# Altium schematic sheet 控制板.SchDoc (part 2 of 2)
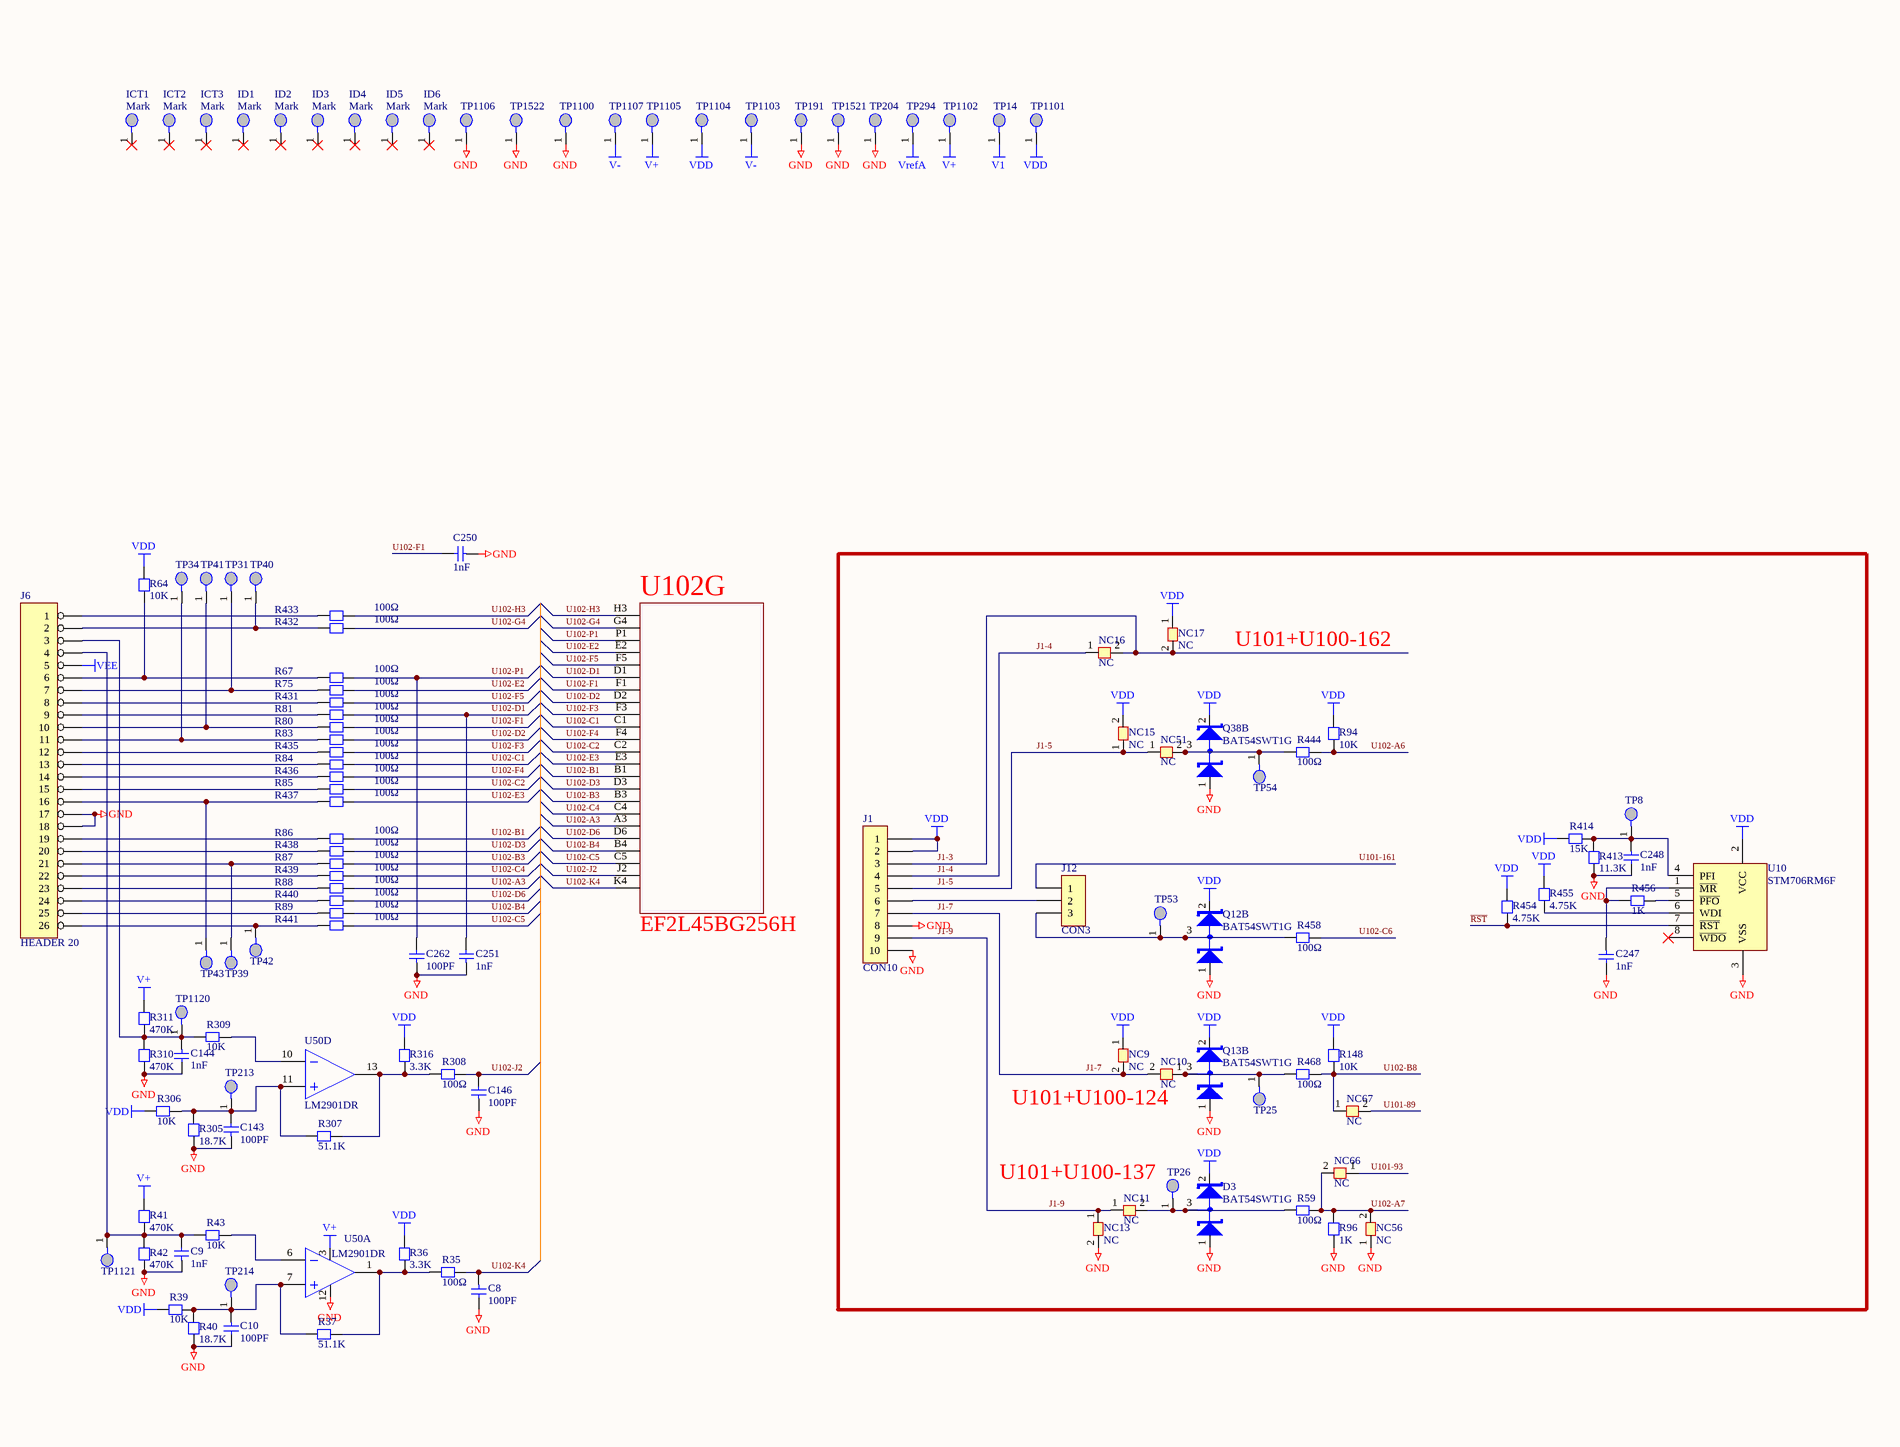
[diagram p12: 控制板.SchDoc, bottom column 4 of 4]

## Nets
GND: C4.1 C5.2 C6.1 C7.1 C8.2 C9.1 C10.2 C11.2 C12.1 C13.2 C14.1 C15.2 C16.1 C17.2 C18.2 C19.1 C20.2 C21.2 C22.2 C23.1 C24.1 C25.1 C26.2 C27.2 C28.1 C29.1 C30.1 C31.1 C32.2 C33.1 C34.1 C35.2 C36.2 C37.2 C38.2 C39.1 C40.2 C41.1 C42.1 C43.2 C44.2 C45.2 C46.1 C47.1 C48.1 C49.1 C50.2 C51.1 C52.2 C53.1 C54.1 C55.1 C56.2 C57.1 C58.1 C59.1 C60.2 C61.2 C62.2 C63.1 C64.2 C65.1 C66.2 C67.1 C68.2 C100.1 C101.1 C102.2 C103.2 C104.1 C110.2 C111.2 C116.2 C123.2 C124.1 C126.2 C127.2 C128.2 C130.1 C131.1 C132.1 C133.2 C134.1 C135.2 C136.1 C137.1 C138.1 C140.2 C141.1 C142.2 C143.1 C144.2 C145.2 C146.1 C147.1 C148.1 C149.1 C150.1 C151.1 C152.1 C153.2 C154.2 C155.1 C156.1 C157.2 C158.1 C159.1 C160.2 C161.2 C162.1 C163.1 C164.2 C165.2 C167.2 C168.1 C169.1 C170.2 C171.1 C172.1 C173.1 C174.1 C175.2 C176.1 C177.1 C178.1 C179.1 C180.2 C181.1 C182.1 C183.1 C184.1 C185.2 C186.1 C187.2 C188.1 C189.1 C190.2 C191.2 C192.2 C193.2 C194.1 C195.1 C196.1 C197.1 C198.2 C199.2 C200.2 C201.2 C202.1 C203.1 C204.1 C205.1 C206.1 C207.2 C208.1 C209.1 C210.1 C211.1 C212.1 C213.1 C214.1 C215.1 C216.1 C217.1 C218.1 C219.1 C220.1 C221.1 C222.1 C223.2 C224.2 C225.2 C226.2 C227.2 C228.2 C229.2 C230.2 C231.1 C232.1 C233.2 C234.2 C235.2 C236.2 C237.2 C238.2 C239.2 C240.2 C241.2 C242.2 C243.2 C244.1 C245.1 C246.1 C247.2 C248.2 C249.2 C250.1 C251.1 C252.2 C253.1 C254.1 C255.2 C256.1 C257.1 C258.2 C259.1 C260.1 C261.1 C262.1 C263.2 C264.1 C265.1 C266.2 C267.2 C268.1 C269.2 C270.2 C271.2 C272.1 C273.1 C274.2 C275.2 C276.1 C277.2 C278.2 C279.1 C280.1 C281.1 C282.1 C283.1 C284.1 C285.1 C286.2 C287.2 C288.2 C289.2 C290.2 C300.1 C301.1 C302.1 C303.1 C304.1 C305.1 C306.1 C307.1 C308.1 C309.1 C310.1 C311.1 C312.1 C313.1 C314.1 C315.1 C316.1 C317.1 C318.1 C319.1 C320.1 C321.1 C322.1 C323.2 C324.2 C325.2 C326.1 C327.1 C328.1 C329.2 C330.2 C331.2 C332.1 C333.1 C334.1 C335.1 C336.1 C337.1 C338.2 C339.2 C340.2 C341.1 C342.1 C343.1 C344.1 C345.1 C346.1 C347.1 C348.1 C349.1 C350.2 C351.1 C352.1 C353.1 C354.1 C355.1 C356.1 C357.1 C358.2 C359.2 C360.1 C361.1 C362.1 C363.1 C364.1 C365.1 C366.2 C367.2 C368.2 C369.1 C370.1 C371.2 C372.2 C373.2 C374.2 C375.2 C376.2 C377.2 C378.2 C379.2 C380.1 C381.2 C382.2 C383.1 C384.2 C385.2 C387.1 C388.1 C389.2 C390.2 C391.2 C392.2 C393.2 C394.2 C395.2 C396.2 C397.1 C398.1 C399.2 C400.2 C401.2 C402.2 C403.2 C404.2 C405.2 C406.2 C407.2 C408.2 C409.2 C410.1 C411.1 C413.1 C414.2 C415.1 C416.1 C417.1 C418.2 C419.1 C420.1 C421.2 C422.2 C423.1 C424.1 C425.2 C428.2 C429.1 C430.2 C431.1 C433.1 C434.2 C438.1 C439.1 C440.2 C442.1 C443.1 C444.2 C446.1 C447.2 C448.2 C449.1 C450.2 C451.2 C452.2 C453.1 C454.2 C455.2 C456.1 C457.1 C458.2 C459.2 C460.1 C461.2 C462.2 C463.1 C465.2 C466.2 C467.1 C469.1 C470.2 C473.2 C474.1 C475.1 C476.2 C477.2 C478.1 C479.2 C480.1 C481.2 C482.1 C483.1 C484.2 C485.2 C486.1 C487.2 C488.1 C492.2 C493.1 C495.1 C496.1 C497.1 C498.2 D3.1(A) D48.1 D52.1 D54.1 D55.1 D60.1 D61.1 D65.1 D68.1 D1500.1(A) D1504.1(A) D1506.1(A) D1507.1(A) D1508.1(A) D1510.1(A) D1513.1(A) D1515.1(A) D1516.1(A) D1517.1(A) D1522.1(A) D1524.1(A) D1527.1(A) D1529.1(A) D1530.1(A) D1534.1(A) D1535.1(A) D1536.1(A) D1537.1(A) D1539.1(A) D1541.1(A) D1542.1(A) D1543.1(A) D1544.1(A) D1546.1(A) J1.8 J1.10 J2.25 J2.26 J3.7 J3.25 J3.26 J4.7 J4.8 J5.6 J5.17 J6.17 J6.18 J7.1 J7.2 J7.5 J7.19 NC1.1 NC13.2 NC21.1 NC26.2 NC31.2 NC39.1 NC40.1 NC45.1 NC46.1 NC47.1 NC50.1 NC52.2 NC53.1 NC54.1 NC55.2 NC56.1 NC57.1 NC59.2 NC60.2 NC61.2 OSC1.2(GND) OSC2.2(GND) Q1B.2(E) Q2.2(E) Q2B.1(A) Q3B.1(A) Q4B.1(A) Q5B.1(A) Q6B.1(A) Q7B.1(A) Q8B.1(A) Q9.2(E) Q9B.1(A) Q10.2(E) Q10B.1(A) Q11.2(E) Q11B.1(A) Q12B.1(A) Q13.2(E) Q13B.1(A) Q14.2(E) Q14B.1(A) Q15.2(E) Q15B.1(A) Q16.2(E) Q16B.1(A) Q17B.1(A) Q18B.1(A) Q19B.1(A) Q20B.1(A) Q21B.1(A) Q22B.1(A) Q23B.1(A) Q24B.1(A) Q25B.1(A) Q26B.1(A) Q27B.2(E) Q28B.1 Q29B.1 Q30B.1 Q31B.1 Q32B.1 Q33B.1 Q34B.1 Q35B.1 Q36B.1 Q37B.1 Q38B.1(A) R19.2 R30.1 R40.1 R42.2 R52.1 R53.1 R58.2 R96.1 R108.2 R111.2 R125.1 R190.1 R193.2 R196.2 R199.2 R250.1 R251.1 R252.1 R260.1 R261.1 R262.1 R263.1 R266.2 R270.2 R279.1 R280.2 R288.2 R292.2 R294.1 R298.1 R303.1 R305.1 R310.2 R321.2 R330.1 R352.2 R367.2 R369.1 R370.1 R373.1 R375.1 R378.2 R379.2 R380.2 R381.2 R382.2 R387.2 R388.2 R390.2 R394.2 R395.2 R399.1 R400.1 R401.2 R402.2 R403.2 R404.1 R405.2 R407.2 R413.2 R416.2 R417.2 R418.2 R425.1 R426.1 R430.1 R451.1 R452.2 R471.1 R477.1 R481.1 R482.1 R483.1 R496.2 R497.2 R500.2 R504.2 R505.2 R506.2 R507.2 R508.2 R540.2 R543.2 R550.1 R565.2 R566.2 R577.2 R578.2 R579.2 R580.2 R581.2 R582.2 R592.1 R594.2 R596.2 R606.2 R607.2 R610.2 R611.2 R616.2 R618.2 R619.2 R622.2 R625.2 R636.2 R638.2 R639.1 R641.2 R664.1 R666.1 R669.2 R675.2 R676.2 R677.1 R679.2 R687.2 R690.2 R695.2 R698.2 R706.1 R709.1 R713.1 R716.1 R742.1 R744.1 R745.2 R749.1 R752.2 R755.1 R761.1 R767.2 R768.2 R771.2 R773.1 R776.2 R782.2 R783.1 R792.2 R793.2 R796.1 R797.2 R799.2 R800.1 R803.2 TP191.1 TP204.1 TP1100.1 TP1106.1 TP1521.1 TP1522.1 U1.1(Y4) U1.2(Y6) U1.4(Y7) U1.5(Y5) U1.6(E) U1.8(GND) U1.9(S2) U1.10(S1) U1.12(Y3) U1.15(Y2) U2.2(Y6) U2.4(Y7) U2.6(E) U2.8(GND) U3.8(GND) U4.6(E) U4.8(GND) U5.1(C) U7.6(E) U7.8(GND) U9.8(GND) U10.3(VSS) U11.8(GND) U12.8(GND) U16.1(GND) U17.1(GND) U18.1(GND) U19.1(GND) U20.1(GND) U21.1(GND) U24.1(E0) U24.2(E1) U24.3(E2) U24.4(VSS) U25.1(E0) U25.2(E1) U25.3(E2) U25.4(VSS) U26.2 U27.1 U29.2(K) U30.4 U36.8(GND) U50.12(V-) U100.14(VSS) U100.22(VSS) U100.37(VSSA) U100.61(VSS) U100.71(VSS) U100.90(VSS) U100.102(VSS) U100.113(VSS) U100.126(VSS) U100.135(VSS) U100.148(VSS) U100.158(VSS) U101.14(VSS) U101.22(VSS) U101.37(VSSA) U101.61(VSS) U101.71(VSS) U101.90(VSS) U101.102(VSS) U101.113(VSS) U101.126(VSS) U101.135(VSS) U101.148(VSS) U101.158(VSS) U102.B2 U102.B15 U102.C3 U102.C14 U102.D4 U102.D13 U102.E5 U102.E12 U102.F6 U102.F11 U102.H8 U102.H9 U102.J8 U102.J9 U102.L6 U102.L11 U102.M5 U102.M12 U102.N4 U102.N13 U102.P3 U102.P14 U102.R2 U102.R15 U203.12(V-) U206.12(V-) U211.12(V-) U212.12(V-) U213.12(V-)
V1: C5.1 C135.1 C153.1 C161.1 J7.6 NC37.2 NC38.2 NC42.1 NC59.1 R271.2 R281.2 R284.2 R291.2 R304.1 R604.2 R647.2 R649.1 R650.1 R657.1 R663.1 R718.1 R725.1 R726.2 R733.2 TP14.1
V2: C30.2 C108.2 C109.2 C111.1 C114.2 C115.2 C117.2 C118.2 C497.2 J7.20 Q5B.3(C) R282.2 R314.2 R315.2 R358.2 R635.1 TP15.1 TP316.1 U300.2(IN-)
V+: C31.2 C44.1 C45.1 C58.2 C59.2 C60.1 C64.1 C101.2 C110.1 C124.2 C133.1 C137.2 C152.2 C157.1 C160.1 C162.2 C167.1 C168.2 C169.2 C171.2 C176.2 C181.2 C364.2 C368.1 C377.1 C383.2 C397.2 C398.2 C409.1 C420.2 C433.2 C440.1 C453.2 C456.2 C470.1 C477.1 C484.1 J4.9 J4.10 NC1.2 NC2.1 NC12.2 NC37.1 NC38.1 NC50.2 NC53.2 NC54.2 NC70.1 NC71.2 R41.2 R268.1 R296.2 R300.2 R311.2 R597.2 R621.1 R624.1 R627.1 R637.1 TP1102.1 TP1105.1 U1.16(VCC) U2.16(VCC) U4.16(VCC) U7.16(VCC) U11.4(V+) U12.4(V+) U13.4(V+) U16.8(V+) U17.8(V+) U18.8(V+) U19.8(V+) U20.8(V+) U21.8(V+) U36.4(V+) U50.3(V+) U203.3(V+) U206.3(V+) U211.3(V+) U212.3(V+) U213.3(V+) U300.4(V+) U301.4(V+) U302.4(V+) U303.4(V+) U304.4(V+) U306.4(V+) U307.4(V+) U313.4(V+) U320.4(V+) U321.4(V+)
V-: C47.2 C48.2 C103.1 C104.2 C116.1 C127.1 C131.2 C154.1 C159.2 C163.2 C165.1 C175.1 C180.1 C185.1 C189.2 C323.1 C366.1 C380.2 C414.1 C418.1 C434.1 C444.1 C446.2 C451.1 J4.11 J4.12 NC52.1 R167.2 R541.1 R605.2 TP1103.1 TP1107.1 U13.11(V-) U16.4(V-) U17.4(V-) U18.4(V-) U19.4(V-) U20.4(V-) U21.4(V-) U300.11(V-) U301.11(V-) U302.11(V-) U303.11(V-) U304.11(V-) U306.11(V-) U307.11(V-) U313.11(V-) U320.11(V-) U321.11(V-)
VDD: C11.1 C12.2 C13.1 C15.1 C19.2 C26.1 C27.1 C33.2 C34.2 C39.2 C43.1 C50.1 C55.2 C56.1 C63.2 C170.1 C190.1 C191.1 C192.1 C193.1 C194.2 C195.2 C196.2 C202.2 C203.2 C207.1 C212.2 C224.1 C229.1 C230.1 C231.2 C232.2 C234.1 C235.1 C236.1 C237.1 C238.1 C239.1 C240.1 C241.1 C242.1 C243.1 C244.2 C245.2 C246.2 C249.1 C252.1 C253.2 C254.2 C255.1 C256.2 C257.2 C258.1 C259.2 C260.2 C263.1 C265.2 C266.1 C267.1 C268.2 C269.1 C270.1 C271.1 C272.2 C273.2 C274.1 C275.1 C276.2 C277.1 C278.1 C279.2 C280.2 C281.2 C326.2 C327.2 C328.2 C358.1 C362.2 C370.2 C496.2 D3.2(C) D48.2 D52.2 D54.2 D55.2 D60.2 D61.2 D65.2 D66.1 D67.1 D68.2 D69.1 D1500.2(C) D1504.2(C) D1506.2(C) D1507.2(C) D1508.2(C) D1510.2(C) D1513.2(C) D1515.2(C) D1516.2(C) D1517.2(C) D1522.2(C) D1524.2(C) D1527.2(C) D1529.2(C) D1530.2(C) D1534.2(C) D1535.2(C) D1536.2(C) D1537.2(C) D1539.2(C) D1541.2(C) D1542.2(C) D1543.2(C) D1544.2(C) D1546.2(C) J1.1 J1.2 J4.5 J4.6 LB1.2 LB2.1 LB4.2 LB6.1 NC3.2 NC5.1 NC6.2 NC7.2 NC8.1 NC9.1 NC15.2 NC17.1 NC21.2 NC22.2 NC23.1 NC24.1 NC25.1 NC28.2 NC32.2 NC33.1 NC34.1 NC35.2 NC36.1 NC55.1 NC57.2 NC58.1 NC62.1 NC64.1 NC68.2 NC69.2 Q2B.2(C) Q3B.2(C) Q4B.2(C) Q5B.2(C) Q6B.2(C) Q7B.2(C) Q8B.2(C) Q9B.2(C) Q10B.2(C) Q11B.2(C) Q12B.2(C) Q13B.2(C) Q14B.2(C) Q15B.2(C) Q16B.2(C) Q17B.2(C) Q18B.2(C) Q19B.2(C) Q20B.2(C) Q21B.2(C) Q22B.2(C) Q23B.2(C) Q24B.2(C) Q25B.2(C) Q26B.2(C) Q28B.2 Q29B.2 Q30B.2 Q31B.2 Q32B.2 Q33B.2 Q34B.2 Q35B.2 Q36B.2 Q37B.2 Q38B.2(C) R21.2 R36.2 R39.1 R55.2 R56.2 R60.1 R64.1 R94.1 R104.1 R112.1 R148.2 R169.2 R173.1 R174.2 R306.1 R316.1 R317.2 R328.1 R331.2 R332.1 R336.1 R340.2 R348.2 R349.2 R350.2 R351.2 R353.2 R354.2 R374.1 R376.1 R377.2 R383.2 R384.1 R385.1 R386.1 R389.2 R391.2 R392.2 R393.2 R397.1 R398.1 R406.2 R408.2 R409.2 R410.2 R411.1 R412.1 R414.1 R415.2 R419.2 R420.2 R421.2 R424.1 R427.1 R428.1 R429.1 R454.1 R455.1 R457.1 R467.2 R472.1 R473.1 R474.1 R475.1 R476.1 R478.1 R479.1 R480.1 R488.1 R490.1 R492.2 R493.1 R494.1 R495.2 R498.2 R499.2 R501.2 R502.2 R503.2 R509.2 R510.2 R511.2 R512.1 R513.1 R514.1 R515.1 R516.1 R517.1 R518.2 R522.1 R523.1 R525.1 R526.1 R527.1 R528.2 R529.1 R530.1 R531.1 R532.1 R533.1 R534.2 R535.2 R536.2 R537.2 R538.2 R539.2 R564.2 R574.2 R575.2 R583.2 R584.2 R585.2 R586.1 R587.1 R608.2 R609.2 R615.2 R617.2 R672.2 R673.2 R681.2 R682.2 R735.2 R736.2 R739.1 R740.1 R758.2 R759.2 R764.2 R765.2 R785.2 R786.2 R789.2 R790.2 TP1101.1 TP1104.1 U3.4(V+) U9.4(V+) U10.2(VCC) U24.8(VCC) U25.8(VCC) U30.8 U100.6(VBAT) U100.15(VDD) U100.23(VDD) U100.36(VDDA) U100.49(VDD) U100.62(VDD) U100.72(VDD) U100.82(VDD) U100.91(VDD) U100.103(VDD) U100.114(VDDUSB) U100.127(VDD) U100.136(VDD) U100.149(VDD) U100.159(VDD) U100.172(VDD) U101.6(VBAT) U101.15(VDD) U101.23(VDD) U101.36(VDDA) U101.49(VDD) U101.62(VDD) U101.72(VDD) U101.82(VDD) U101.91(VDD) U101.103(VDD) U101.114(VDDUSB) U101.127(VDD) U101.136(VDD) U101.149(VDD) U101.159(VDD) U101.172(VDD) U102.A1 U102.A2 U102.A16 U102.D5 U102.D12 U102.E4 U102.E13 U102.G7 U102.G8 U102.G9 U102.G10 U102.H7 U102.H10 U102.J7 U102.J10 U102.K7 U102.K8 U102.K9 U102.K10 U102.M4 U102.M13 U102.N5 U102.N12 U102.T1 U102.T16
VEE: C32.1 C49.2 C331.1 C378.1 C379.1 C403.1 C408.1 C498.1 J6.5 R167.1 R541.2 R542.2 TP16.1 U1.7(VEE) U2.7(VEE) U4.7(VEE) U5.3(A) U7.7(VEE)
VreB: R255.1 R334.2 R338.2 R342.1 TP21.1 U306.1(OUT) U306.2(IN-)
VREF: C57.2 C363.2 NC2.2 NC71.1 R257.2 R297.2 R590.2 TP44.1 U26.1 U36.7(VOUT)
VREF+: C46.2 C217.2 C218.2 C322.2 C350.1 C351.2 NC12.1 NC60.1 NC70.2 TP11.1 U11.7(VOUT) U100.38(VREF+) U101.38(VREF+)
VrefA: C386.1 C464.2 C468.2 C471.2 C472.1 C489.2 C490.1 C491.1 C494.1 J3.10 R600.2 R614.1 R747.2 R748.1 R750.1 R762.1 R769.2 R772.2 R780.2 R781.1 TP294.1 U307.13(IN-) U307.14(OUT)
VrefC: C156.2 C166.2 R324.1 R330.2 TP153.1 U16.2(IN+) U17.2(IN+) U18.2(IN+)
VrefD: C186.2 C187.1 NC36.2 NC48.2 Q6B.3(C) R359.2 R633.1 TP20.1 U9.7(VOUT) U27.3
VrefE: C14.2 C188.2 D1527.3(C) NC44.1 R21.1 R360.2 R634.1 TP19.1 U3.7(VOUT) U29.1(A)
J1-3: J1.3 NC16.2 NC17.2 U100.162(PB4) U101.162(PB4)
J1-4: J1.4 NC16.1
J1-5: J1.5 NC14.2 NC15.1 NC51.1
J1-7: J1.7 NC9.2 NC10.2 U100.124(PA13) U101.124(PA13)
J1-9: J1.9 NC11.1 NC13.1 U100.137(PA14) U101.137(PA14)
J2-1: D1507.3(C) J2.1 R556.2
J2-2: J2.2 Q23B.3(C) R571.2
J2-3: J2.3 Q24B.3(C) R557.2
J2-4: J2.4 Q15B.3(C) R545.1
J2-5: J2.5 Q20B.3(C) R568.2
J2-6: D1506.3(C) J2.6 R168.1
J2-7: J2.7 R640.2 TP501.1
J2-8: J2.8 R642.1 TP500.1
J2-9: J2.9 R697.2 TP516.1
J2-10: J2.10 R701.2 TP502.1
J2-11: J2.11 R696.2 TP209.1
J2-12: J2.12 R694.2 TP515.1
J2-13: J2.13 R688.2 TP507.1
J2-14: J2.14 R686.1 TP503.1
J2-15: J2.15 R689.2 TP508.1
J2-16: J2.16 R691.1 TP514.1
J2-17: J2.17 R715.1 TP506.1
J2-18: J2.18 R717.1 TP510.1
J2-19: J2.19 R714.1 TP504.1
J2-20: J2.20 R705.2 TP1509.1
J2-21: J2.21 R707.1 TP517.1
J2-22: J2.22 R702.1 TP511.1
J2-23: J2.23 R708.1 TP513.1
J2-24: J2.24 R710.2 TP512.1
J3-1: J3.1 R164.2 TP2.1
J3-2: D1516.3(C) J3.2 R561.2
J3-3: J3.3 R165.2
J3-4: D1517.3(C) J3.4 R572.2
J3-5: J3.5 R166.2
J3-6: J3.6 Q19B.3(C) R567.2 TP1.1
J3-8: J3.8 R179.2 TP55.1
J3-9: J3.9 R143.1
J3-11: J3.11 R156.1
J3-12: J3.12 R146.1 TP29.1
J3-13: J3.13 R137.1
J3-14: J3.14 R157.1
J3-15: J3.15 R147.1 TP30.1
J3-16: J3.16 R138.1
J3-17: J3.17 R144.1
J3-18: J3.18 R145.1
J3-19: D1530.3(C) J3.19 Q21B.3(C) R48.1 R569.2
J3-20: D1529.3(C) J3.20 Q26B.3(C) R49.1 R562.2 TP28.1
J3-21: J3.21 R602.1 TP3.1
J3-22: J3.22 Q25B.3(C) R559.2
J3-23: D1522.3(C) J3.23 R560.2 TP27.1
J3-24: J3.24 Q22B.3(C) R570.2
J7-3: D1539.3(C) J7.3 R325.1 R362.2 TP1516.1
J7-4: J7.4 Q8B.3(C) R45.1 R312.1 TP1517.1
J7-7: D1537.3(C) J7.7 R363.2
J7-8: D1536.3(C) J7.8 R46.1 TP46.1
J7-9: J7.9 Q3B.3(C) R356.2
J7-10: D1546.3(C) J7.10 R26.2
J7-11: D1541.3(C) J7.11 R29.1 TP24.1
J7-12: J7.12 Q2B.3(C) R357.2
J7-13: J7.13 R18.2 R269.1 TP1506.1
J7-14: J7.14 R15.1 R275.1 TP1505.1
J7-15: J7.15 R7.1 R293.2 TP1504.1
J7-16: J7.16 R8.2 R276.2 TP1503.1
J7-17: J7.17 R2.2 R278.2 TP1518.1
J7-18: J7.18 R1.1 R287.1 TP1502.1
J7-21: D1524.3(C) J7.21 R361.2 TP23.1
J7-22: J7.22 Q11B.3(C) R50.1 TP22.1
J7-23: J7.23 Q14.3(C) R296.1 U2.10(S1)
J7-24: J7.24 Q15.3(C) R268.2 U2.9(S2)
J7-25: J7.25 Q13.3(C) R300.1 U2.11(S0)
J7-26: J7.26 R61.1 TP1520.1
~{RST}: R23.2 R120.1 R454.2 R553.1 U10.7(~{RST})
U1-3: U1.3(Z) U307.3(IN+)
U1-11: Q16.3(C) R597.1 U1.11(S0)
U1-13: C371.1 R598.1 U1.13(Y0)
U1-14: C372.1 R599.2 U1.14(Y1)
U4-9: Q11.3(C) R621.2 U4.9(S2) U7.9(S2)
U4-10: Q10.3(C) R624.2 U4.10(S1) U7.10(S1)
U4-11: Q9.3(C) R627.2 U4.11(S0) U7.11(S0)
U4-Y1.: C390.1 R178.1 U4.14(Y1)
U4-Y2.: C389.1 R177.1 U4.15(Y2)
U4-Y3.: C392.1 R180.1 U4.12(Y3)
U4-Y4.: C399.1 R628.2 U4.1(Y4)
U4-Y5.: C402.1 R631.2 U4.5(Y5)
U4-Y6.: C400.1 R629.2 U4.2(Y6)
U4-Y7.: C401.1 R630.2 U4.4(Y7)
U7-Y1.: C394.1 R182.1 U7.14(Y1)
U7-Y2.: C393.1 R181.1 U7.15(Y2)
U7-Y3.: C396.1 R184.1 U7.12(Y3)
U7-Y4.: C404.1 R632.2 U7.1(Y4)
U7-Y6.: C405.1 R633.2 U7.2(Y6)
U7-Y7.: C406.1 R634.2 U7.4(Y7)
U100-19: C349.2 R562.1 U100.19(PF3)
U100-20: C357.2 R572.1 U100.20(PF4)
U100-21: C348.2 R561.1 U100.21(PF5)
U100-24: C356.2 R571.1 U100.24(PF6)
U100-25: C347.2 R560.1 U100.25(PF7)
U100-26: C355.2 R570.1 U100.26(PF8)
U100-27: C346.2 R559.1 U100.27(PF9)
U100-28: C354.2 R569.1 U100.28(PF10)
U100-32: C345.2 R558.1 U100.32(PC0)
U100-33: C353.2 R568.1 U100.33(PC1)
U100-34: C344.2 R557.1 U100.34(PC2)
U100-35: C343.2 R556.1 U100.35(PC3)
U100-40: C342.2 R555.1 U100.40(PA0)
U100-41: C352.2 R567.1 U100.41(PA1)
U100-42: C341.2 R554.1 U100.42(PA2)
U100-47: C337.2 R549.2 U100.47(PA3)
U100-50: C340.1 R552.1 U100.50(PA4)
U100-51: C336.2 R548.2 U100.51(PA5)
U100-52: C339.1 R551.1 U100.52(PA6)
U100-53: C335.2 R547.2 U100.53(PA7)
U100-54: C338.1 R168.2 U100.54(PC4)
U100-55: C333.2 R545.2 U100.55(PC5)
U100-56: C334.2 R546.2 U100.56(PB0)
U100-57: C332.2 R544.2 U100.57(PB1)
U100-64: R166.1 R537.1 U100.64(PF14)
U100-65: R165.1 R539.1 U100.65(PF15)
U100-66: R164.1 R536.1 U100.66(PG0)
U100-92: R163.2 R472.2 U100.92(PB12)
U100-93: R162.2 R498.1 U100.93(PB13)
U100-119: R484.2 R508.1 U100.119(PA8)
U100-120: R485.2 R509.1 U100.120(PA9)
U100-121: R486.2 R510.1 U100.121(PA10)
U100-123: R487.2 R511.1 U100.123(PA12)
U100-131: R488.2 R489.2 U100.131(PI0)
U100-132: R490.2 R491.2 U100.132(PI1)
U100-133: R523.2 R524.2 U100.133(PI2)
U100-134: R521.2 R522.2 U100.134(PI3)
U100-139: R518.1 R519.1 U100.139(PC10)
U100-140: R520.1 R525.2 U100.140(PC11)
U100-167: R171.1 R581.1 U100.167(PB8)
U100-173: R172.2 R173.2 U100.173(PI4)
U100-174: R583.1 R588.2 U100.174(PI5)
U100-175: R174.1 R175.1 U100.175(PI6)
U100-176: R584.1 R589.2 U100.176(PI7)
U101-1: R34.2 R349.1 U101.1(PE2)
U101-3: R33.2 R350.1 U101.3(PE4)
U101-4: R32.2 R377.1 U101.4(PE5)
U101-5: R31.2 R351.1 U101.5(PE6)
U101-19: C204.2 R29.2 U101.19(PF3)
U101-20: C205.2 R355.1 U101.20(PF4)
U101-21: C206.2 R27.1 U101.21(PF5)
U101-24: C198.1 R356.1 U101.24(PF6)
U101-25: C208.2 R26.1 U101.25(PF7)
U101-26: C199.1 R25.1 U101.26(PF8)
U101-27: C209.2 R24.1 U101.27(PF9)
U101-28: C200.1 R357.1 U101.28(PF10)
U101-35: C213.2 R361.1 U101.35(PC3)
U101-40: C214.2 R362.1 U101.40(PA0)
U101-41: C215.2 R363.1 U101.41(PA1)
U101-42: C216.2 R364.1 U101.42(PA2)
U101-47: C223.1 R44.2 U101.47(PA3)
U101-50: C219.2 R45.2 U101.50(PA4)
U101-51: C225.1 R46.2 U101.51(PA5)
U101-52: C220.2 R368.1 U101.52(PA6)
U101-53: C226.1 R47.2 U101.53(PA7)
U101-54: C221.2 R48.2 U101.54(PC4)
U101-55: C227.1 R49.2 U101.55(PC5)
U101-56: C222.2 R396.2 U101.56(PB0)
U101-57: C228.1 R50.2 U101.57(PB1)
U101-89: NC67.2 U101.89(PH12)
U101-93: NC66.1 U101.93(PB13)
U101-122: R423.2 R424.2 U101.122(PA11)
U101-123: R415.1 R422.2 U101.123(PA12)
U101-138: NC4.1 U101.138(PA15)
U101-140: R62.2 R385.2 U101.140(PC11)
U101-144: R60.2 R61.2 U101.144(PD2)
U101-161: J12.1 U101.161(PB3)
U101-174: R347.1 R348.1 U101.174(PI5)
U101-175: R56.1 R57.1 U101.175(PI6)
U101-176: R54.1 R55.1 U101.176(PI7)
U102-A3: R88.2 U102.A3
U102-A4: R90.2 U102.A4
U102-A5: R92.2 U102.A5
U102-A6: NC63.2 R94.2 R444.2 U102.A6
U102-A7: NC56.2 NC66.2 R59.1 R96.2 U102.A7
U102-A8: C302.2 R131.2 U102.A8
U102-A9: R478.2 U100.105(PD15) U102.A9
U102-A10: R99.2 U102.A10
U102-A11: R100.2 U102.A11
U102-A12: R102.2 U102.A12
U102-A14: R106.2 U102.A14
U102-A15: R109.2 U102.A15
U102-B1: R86.2 U102.B1
U102-B3: R87.2 U102.B3
U102-B4: R89.2 U102.B4
U102-B5: R91.2 U102.B5
U102-B6: R93.2 U102.B6
U102-B7: R95.2 U102.B7
U102-B8: NC67.1 R148.1 R468.1 U102.B8
U102-B9: R98.2 U102.B9
U102-B10: R82.1 R112.2 U102.B10
U102-B11: R101.2 U102.B11
U102-B12: R103.2 U102.B12
U102-B13: R105.2 U102.B13
U102-B14: R107.2 U102.B14
U102-B16: R110.2 U102.B16
U102-C1: R84.2 U102.C1
U102-C2: R85.2 U102.C2
U102-C4: R439.2 U102.C4
U102-C5: R441.2 U102.C5
U102-C6: NC65.2 R458.1 U102.C6
U102-C7: R445.2 U102.C7
U102-C8: R113.2 U102.C8
U102-C9: R114.2 U102.C9
U102-C11: R461.1 U102.C11
U102-C12: R463.1 U102.C12
U102-C15: R476.2 U100.98(PD10) U102.C15
U102-C16: R500.1 U100.100(PD12) U102.C16
U102-D1: C251.2 R81.1 U102.D1
U102-D2: R83.2 U102.D2
U102-D3: R438.2 U102.D3
U102-D6: R440.2 U102.D6
U102-D7: R443.2 U102.D7
U102-D8: R97.2 U102.D8
U102-D9: R459.1 U102.D9
U102-D10: R460.1 U102.D10
U102-D11: R462.1 U102.D11
U102-D14: R464.1 U102.D14
U102-D15: R477.2 U100.101(PD13) U102.D15
U102-D16: R501.1 U100.104(PD14) U102.D16
U102-E1: R483.2 U100.112(PG8) U102.E1
U102-E2: R75.1 U102.E2
U102-E3: R437.2 U102.E3
U102-E6: R442.2 U102.E6
U102-E7: R446.2 U102.E7
U102-E8: R447.2 U102.E8
U102-E9: R449.2 U102.E9
U102-E10: C284.2 R117.2 U102.E10
U102-E11: R494.2 U100.83(PH6) U102.E11
U102-E14: R465.1 U102.E14
U102-E15: R502.1 U100.106(PG2) U102.E15
U102-E16: R479.2 U100.107(PG3) U102.E16
U102-F1: C250.2 R80.1 U102.F1
U102-F2: R506.1 U100.117(PC8) U102.F2
U102-F3: R435.2 U102.F3
U102-F4: R436.2 U102.F4
U102-F5: R431.1 U102.F5
U102-F7: R119.2 U102.F7
U102-F8: C282.2 R115.2 U102.F8
U102-F9: R448.2 U102.F9
U102-F10: R495.1 U100.87(PH10) U102.F10
U102-F12: R474.2 U100.96(PD8) U102.F12
U102-F13: R466.1 U102.F13
U102-F14: R535.1 U100.68(PE7) U102.F14
U102-F15: R503.1 U100.108(PG4) U102.F15
U102-F16: R480.2 U100.109(PG5) U102.F16
U102-G1: R77.2 U102.G1